# EasyEDA Pro project Foc驱动板.eprj, board PCB1 (continued)
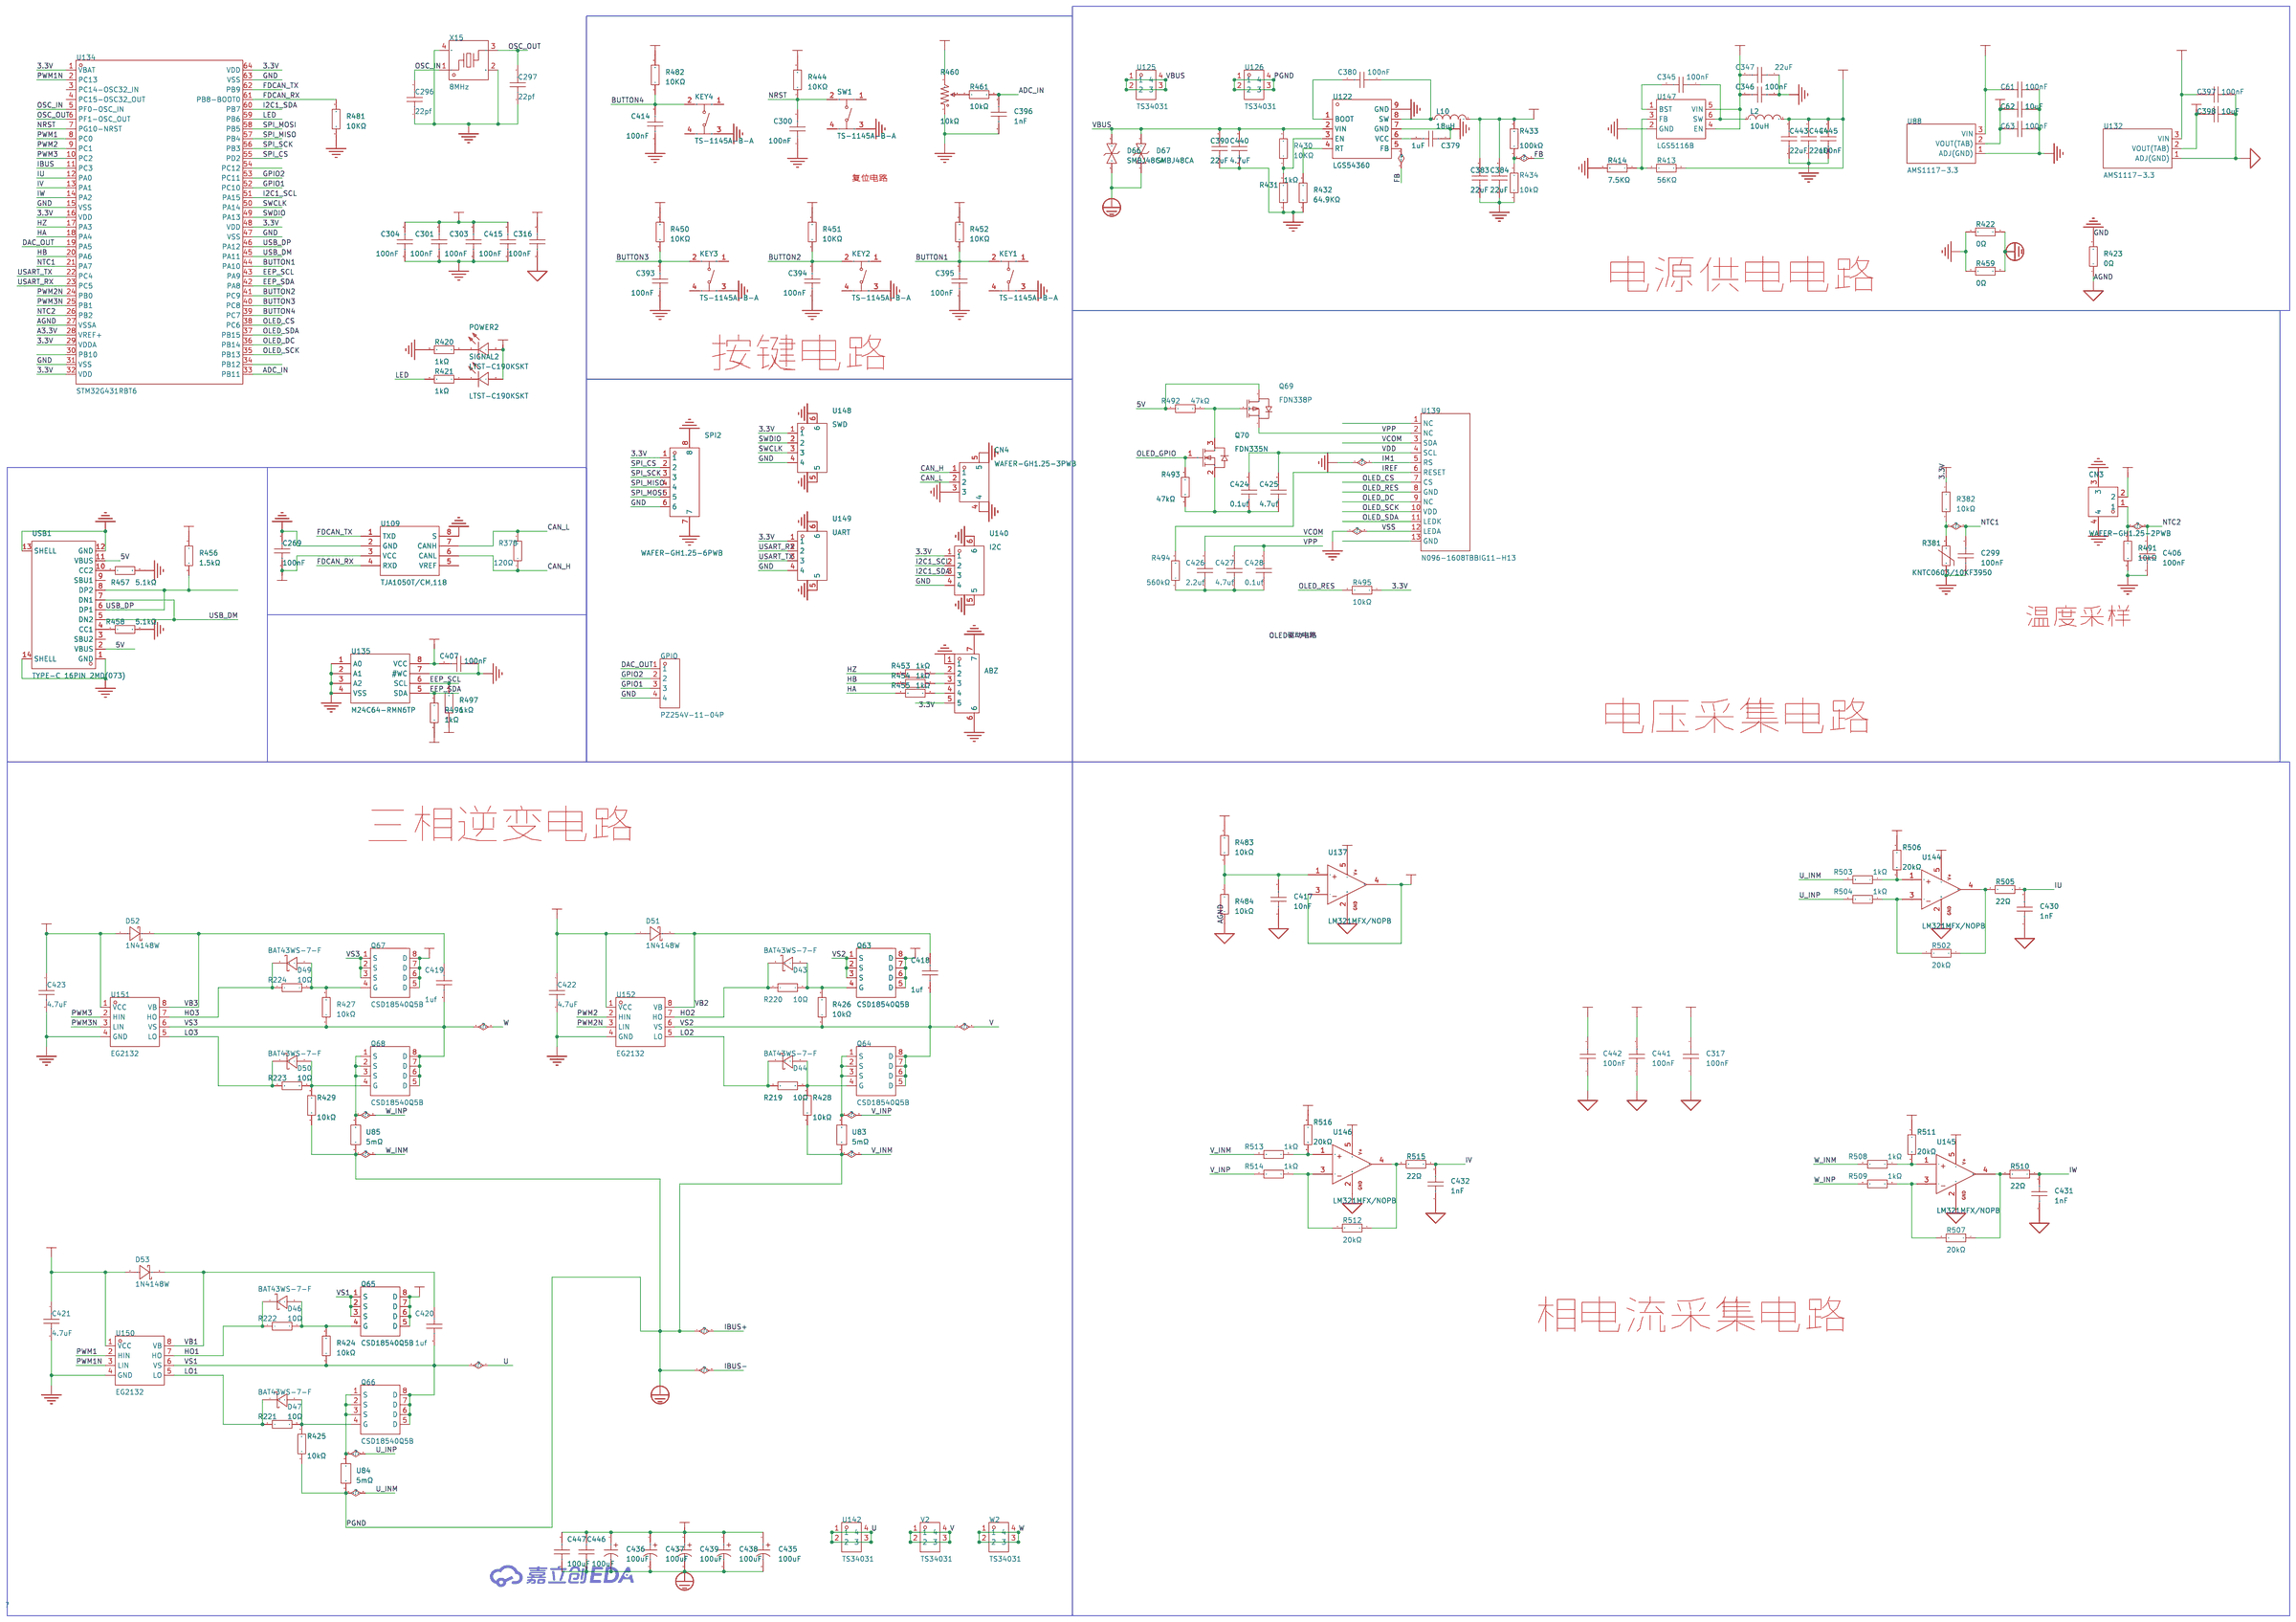
[diagram p0: schematic sheet]
## Routing (per net, layer and track width the routed paths; a pad name or vN(x,y) marks a point on that pad's centre or on a via; arc(x,y) is an arc through that point) (continued)
PWM3N: length 25.5
  Top Layer w0.127: v2(42.8,46.35) U151.3 ; 42.07,68.45 v2(43.35,68.45)
  Bottom Layer w0.127: v2(42.8,46.35) 42.8,68.2 43.05,68.45 v2(43.35,68.45)
SPI_CS: length 67.9
  Top Layer w0.127: U134.55 12.33,68.95 12.08,69.2 v1(10.66,69.2) ; v1(9.78,55.5) 9.02,54.74 9.02,25.65 8.61,25.24 5.51,25.24
  Bottom Layer w0.127: v1(10.66,69.2) 10.03,68.58 10.03,55.75 v1(9.78,55.5)
SPI_MISO: length 69
  Top Layer w0.127: v1(10.67,54.48) 9.78,53.59 9.78,23.11 9.41,22.74 5.51,22.74 ; U134.57 11.65,67.95 v1(11.64,67.94)
  Bottom Layer w0.127: v1(11.64,67.94) 10.92,67.22 10.92,54.74 v1(10.67,54.48)
SPI_MOSI: length 69.7
  Top Layer w0.127: 5.51,21.49 9.81,21.49 10.16,21.84 10.16,53.09 v1(10.67,53.59) ; v1(11.68,67.07) 12.06,67.45 U134.58
  Bottom Layer w0.127: v1(10.67,53.59) 11.43,54.36 11.43,66.81 v1(11.68,67.07)
SPI_SCK: length 68.5
  Top Layer w0.127: v1(10.79,68.2) 11.3,68.71 11.94,68.71 12.2,68.45 U134.56 ; v1(9.78,54.61) 9.4,54.23 9.4,24.38 9.01,23.99 5.51,23.99
  Bottom Layer w0.127: v1(10.79,68.2) 10.41,67.82 10.41,55.24 v1(9.78,54.61)
SWCLK: length 27.6
  Top Layer w0.127: 5.38,74.3 5.39,74.3 7.37,74.3 7.62,74.04 7.62,71.88 8.05,71.45 U134.50
SWDIO: length 28.7
  Top Layer w0.127: U134.49 28.64,71.95 28.45,71.75 8.38,71.75 8,72.14 8,75.31 7.75,75.56 5.39,75.56 5.38,75.55
U: length 26.3
  Top Layer w0.254: C420.2 17.65,40.77 v1(17.27,40.39) U150.6
  Top Layer w0.381: v1(17.09,26.29) 17.09,26.29 13.84,26.29 13.34,26.79 R424.1
  Bottom Layer w0.381: v1(17.27,40.39) 17.27,26.46 v1(17.09,26.29)
  vias: v1(12.73,3.68) v1(13.64,3.68) v1(14.56,3.68) v1(15.39,3.68) v1(16.34,3.68) v1(17.09,25.27) v1(17.09,24.25) v1(17.09,23.24) v1(17.09,22.22) v1(17.27,7.49) v1(17.27,6.54) v1(17.27,5.63) v1(17.27,4.7) v1(17.27,2.65) v1(17.27,1.7) v1(17.27,0.78) v1(17.3,3.68) v1(18.05,26.29) v1(18.05,25.27) v1(18.05,24.26) v1(18.05,23.24) v1(18.05,22.22) v1(18.29,7.54) v1(18.29,6.58) v1(18.29,5.67) v1(18.29,4.74) v1(18.29,3.68) v1(18.29,2.69) v1(18.29,1.74) v1(18.29,0.82) v1(18.97,26.29) v1(18.97,25.27) v1(18.97,24.26) v1(18.97,23.24) v1(18.97,22.22) v1(19.24,3.68) v1(19.3,7.49) v1(19.3,6.54) v1(19.3,5.63) v1(19.3,4.7) v1(19.3,2.65) v1(19.3,1.7) v1(19.3,0.78) v1(19.92,26.29) v1(19.92,25.27) v1(19.92,24.25) v1(19.92,23.24) v1(19.92,22.22) v1(20.19,3.68) v1(20.88,26.29) v1(20.88,25.27) v1(20.88,24.25) v1(20.88,23.24) v1(20.88,22.22) v1(21.11,3.68) v1(21.94,3.68) v1(22.83,3.68) v1(23.72,3.68)
U_INP: length 45.5
  Top Layer w0.203: v1(14.86,16.13) 15.19,15.8 18.59,15.8 18.92,16.13 18.92,18.56
  Top Layer w0.254: v1(14.22,49.28) 14.87,49.28 IN-.2
  Inner2 w0.203: v1(14.86,16.13) 14.6,15.88 12.32,15.88 12.19,16 12.19,48.89 12.57,49.28 v1(14.22,49.28)
USART_RX: length 44.8
  Top Layer w0.127: U134.23 v2(34.04,67.45) ; v1(6.36,66.55) 6.35,66.54 5.38,66.54
  Bottom Layer w0.127: v2(34.04,67.45) 14.47,67.45 14.22,67.69 14.22,71.37 13.84,71.75 8.13,71.75 7.62,71.25 7.62,67.81 v1(6.36,66.55)
USART_TX: length 45.8
  Top Layer w0.127: U134.22 v2(33.4,66.95) ; 5.38,65.29 6.35,65.29 v1(6.36,65.28)
  Bottom Layer w0.127: v1(6.36,65.28) 8,66.92 8,71.12 8.38,71.5 13.46,71.5 13.84,71.12 13.84,67.44 14.33,66.95 v2(33.4,66.95)
USB_DM: length 64
  Top Layer w0.127: v1(6.1,55.24) 6.1,54.1 5.97,53.97 5.33,53.97 4.83,53.47 4.83,44.7 5.08,44.45 6.35,44.45 ; 6.35,44.45 6.59,44.69 USB.5 ; 6.35,44.45 6.35,43.94 6.6,43.69 7.45,43.69 USB.7 ; v2(34.07,70.61) U134.45
  Inner2 w0.127: v2(34.07,70.61) 12.57,70.61 11.81,71.37 6.1,71.37 5.84,71.12 5.84,55.5 v1(6.1,55.24)
USB_DP: length 68.3
  Top Layer w0.127: USB.6 7.46,44.2 8.38,44.2 8.51,44.07 8.51,43.31 8.39,43.19 USB.8 7.44,43.18 4.32,43.18 4.06,43.43 4.06,50.67 3.8,50.94 3.17,50.94 3.04,51.06 3.04,53.46 3.94,54.36 5.21,54.36 5.33,54.48 5.33,55.2 v1(5.29,55.24) ; v2(33.57,71.12) U134.46
  Inner2 w0.127: v1(5.29,55.24) 5.59,55.54 5.59,71.37 5.97,71.75 11.81,71.75 12.45,71.12 v2(33.57,71.12)
V: length 26.4
  Top Layer w0.254: U152.6 v1(29.46,40.51) 29.91,40.96 C418.2
  Top Layer w0.381: R426.1 27.31,26.92 28.07,26.16 30.87,26.16 v1(30.87,26.16)
  Bottom Layer w0.381: v1(30.87,26.16) 30.48,26.55 30.48,29.84 29.46,30.86 v1(29.46,40.51)
  vias: v1(26.25,3.62) v1(27.17,3.62) v1(28.08,3.62) v1(28.91,3.62) v1(29.86,3.62) v1(30.87,25.14) v1(30.87,24.13) v1(30.87,23.11) v1(30.87,22.09) v1(30.8,7.43) v1(30.8,6.48) v1(30.8,5.56) v1(30.8,4.63) v1(30.82,3.62) v1(30.8,2.58) v1(30.8,1.63) v1(30.8,0.72) v1(31.83,26.16) v1(31.83,25.14) v1(31.83,24.13) v1(31.83,23.11) v1(31.83,22.1) v1(31.81,7.47) v1(31.81,6.52) v1(31.81,5.6) v1(31.81,4.67) v1(31.81,3.62) v1(31.81,2.63) v1(31.81,1.67) v1(31.81,0.76) v1(32.75,26.16) v1(32.75,25.14) v1(32.75,24.13) v1(32.75,23.11) v1(32.75,22.1) v1(32.76,3.62) v1(32.83,7.43) v1(32.83,6.48) v1(32.83,5.56) v1(32.83,4.63) v1(32.83,2.58) v1(32.83,1.63) v1(32.83,0.72) v1(33.7,26.16) v1(33.7,25.14) v1(33.7,24.13) v1(33.7,23.11) v1(33.7,22.09) v1(33.72,3.62) v1(34.66,26.16) v1(34.66,25.14) v1(34.66,24.13) v1(34.66,23.11) v1(34.66,22.09) v1(34.63,3.62) v1(35.46,3.62) v1(36.36,3.62) v1(37.25,3.62)
V_INP: length 45.8
  Top Layer w0.203: 32.77,18.18 32.77,15.75 32.44,15.42 29.03,15.42 v1(28.7,15.75)
  Top Layer w0.254: v1(27.69,49.54) 28.58,49.54 IN-#3.2
  Inner2 w0.203: 27.69,49.53 26.42,49.53 26.03,49.15 26.03,15.75 26.29,15.49 28.45,15.49 v1(28.7,15.75)
VCOM: length 19.2
  Top Layer w0.254: C426.2 31.24,80.55 v1(31.24,81.41) ; 20.95,80.77 20.83,80.77 20.45,80.4 1.3 OLED.3
  Bottom Layer w0.254: v1(31.24,81.41) 21.46,81.41 v1(20.95,80.9)
VPP: length 19.2
  Top Layer w0.254: 27.9,80.52 PMOS.2 ; 27.9,80.52 22.1,80.52 21.15,79.57 1.3 OLED.2 ; 27.9,80.52 29.53,80.52 C427.2 ; 27.9,80.52 C428.2
VREF: length 38.2
  Top Layer w0.254: v1(42.13,53.57) 42.13,52.8 ; v1(14.99,53.59) R506.1 ; v1(45.69,55.37) U137.3 U137.4 ; v1(28.54,53.62) 28.54,52.73
  Inner2 w0.254: v1(14.99,53.59) 28.51,53.59 v1(28.54,53.62) 42.07,53.62 v1(42.13,53.57) 45.44,53.57 45.69,53.82 v1(45.69,55.37)
VS3: length 26.3
  Top Layer w0.254: U151.6 v1(42.8,40.64) 43.25,41.09 C419.2
  Top Layer w0.381: v1(43.63,26.28) 43.63,26.29 40.89,26.29 40.01,27.17 R427.1
  Bottom Layer w0.381: v1(42.8,40.64) 42.8,29.59 43.18,29.21 43.18,26.74 v1(43.63,26.28)
  vias: v1(39.46,3.59) v1(40.38,3.59) v1(41.29,3.59) v1(42.12,3.59) v1(43.07,3.59) v1(43.63,25.27) v1(43.63,24.25) v1(43.63,23.24) v1(43.63,22.22) v1(44,7.4) v1(44,6.45) v1(44,5.53) v1(44,4.6) v1(44.03,3.59) v1(44,2.56) v1(44,1.6) v1(44,0.69) v1(44.59,26.29) v1(44.59,25.27) v1(44.59,24.25) v1(44.59,23.24) v1(44.59,22.22) v1(45.02,7.44) v1(45.02,6.49) v1(45.02,5.57) v1(45.02,4.64) v1(45.02,3.59) v1(45.02,2.6) v1(45.02,1.64) v1(45.02,0.73) v1(45.51,26.29) v1(45.51,25.27) v1(45.51,24.25) v1(45.51,23.24) v1(45.51,22.22) v1(45.97,3.59) v1(46.04,7.4) v1(46.04,6.45) v1(46.04,5.53) v1(46.04,4.6) v1(46.04,2.56) v1(46.04,1.6) v1(46.04,0.69) v1(46.46,26.28) v1(46.46,25.27) v1(46.46,24.25) v1(46.46,23.24) v1(46.46,22.22) v1(46.93,3.59) v1(47.42,26.28) v1(47.42,25.27) v1(47.42,24.25) v1(47.42,23.24) v1(47.42,22.22) v1(47.84,3.59) v1(48.67,3.59) v1(49.57,3.59) v1(50.46,3.59)
W_INP: length 46.2
  Top Layer w0.203: v1(41.4,15.88) 41.73,15.54 45.14,15.54 45.47,15.88 45.47,18.31
  Top Layer w0.254: IN-#2.2 v1(41.28,49.53)
  Inner2 w0.203: v1(41.28,49.53) 39.37,49.53 38.86,49.02 38.86,15.88 39.12,15.62 41.15,15.62 v1(41.4,15.88)
$1N9140: length 5.4
  Top Layer w0.254: POWER.1 42.32,82.14 42.67,81.79 42.67,78.61 42.42,78.36 41.7,78.36 R420.1
$1N9141: length 2.3
  Top Layer w0.254: 41.72,89.38 R421.1
$1N9145:
  vias: v1(52.45,48.39) v1(53.65,48.39) v1(54.61,48.39) v1(55.5,48.39) v1(56.64,48.33) v1(57.78,53.21) v1(57.78,52.28) v1(57.85,51.31) v1(57.85,50.37) v1(57.85,49.34) v1(57.78,48.39) v1(59.69,57.15) v1(59.69,56.26) v1(59.69,55.31) v1(60.58,57.15)
$1N9147: length 7.3
  Top Layer w0.254: U122.6 v1(64.03,56.44) ; C379.2 v1(66.67,59.82)
  Bottom Layer w0.254: v1(66.67,59.82) 64.52,59.82 64.03,59.34 v1(64.03,56.44)
$1N9157: length 9.6
  Top Layer w0.254: R431.2 68.71,45.86 68.71,46.86 68.45,47.12 67.18,47.12 67.06,47.24 R430.1 66.42,48.01 66.17,48.26 66.17,49.91 65.91,50.16 64.39,50.16 64.03,50.52 U122.3
$1N9158: length 4.5
  Top Layer w0.254: U122.4 66.1,51.51 66.29,51.31 68.2,51.31 68.58,50.93 68.58,49.92 R432.2
$1N9186: length 15.1
  Top Layer w0.127: R457.1 1.91,50.29 1.14,49.53 1.14,42.67 1.65,42.16 7.43,42.16 USB.10
$1N9188: length 8.1
  Top Layer w0.127: USB.4 7.43,45.21 5.59,45.21 5.46,45.34 5.46,50.68 5.71,50.94 R458.1
$1N9190: length 6.5
  Top Layer w0.127: 53.59,92.33 53.09,91.83 53.09,89.67 52.97,89.54 R461.1
$1N9204: length 2.8
  Top Layer w0.127: R453.1 7.69,13.7 5.51,13.7
$1N9205: length 2.7
  Top Layer w0.127: 5.51,12.45 8.01,12.45 8.14,12.32
$1N9206: length 3
  Top Layer w0.127: 8.14,10.54 8.14,10.79 7.73,11.2 5.51,11.2
$1N9242: length 11.3
  Top Layer w0.381: Q65.4 v1(21.72,28.47) ; v1(15.49,28.45) R424.2 R222.2 14.85,31.36 D46.2
  Inner2 w0.381: v1(15.49,28.45) 21.7,28.45 v1(21.72,28.47)
$1N9243: length 12.2
  Top Layer w0.381: D47.2 14.85,23.58 R221.2 R425.2 v1(15.75,20.45) ; Q66.4 22.09,20.44 v1(22.1,20.45)
  Inner2 w0.381: v1(22.1,20.45) v1(15.75,20.45)
$1N9259: length 10.9
  Top Layer w0.381: D43.2 28.82,31.21 R220.2 R426.2 29.46,28.32 ; Q63.4 v1(35.56,28.32)
  Inner2 w0.381: v1(29.66,28.32) 35.56,28.32
$1N9267: length 12
  Top Layer w0.381: Q64.4 v1(35.81,20.31) ; v1(29.46,20.32) R428.2 R219.2 28.69,23.46 D44.2
  Inner2 w0.381: v1(35.81,20.31) 35.8,20.32 v1(29.46,20.32)
$1N9279: length 11.7
  Top Layer w0.381: Q68.4 v1(48.51,20.43) ; v1(42.29,20.45) R429.2 R223.2 41.52,23.46 D50.2
  Inner2 w0.381: v1(48.51,20.43) 48.5,20.45 v1(42.29,20.45)
$1N9280: length 11.3
  Top Layer w0.381: 47.43,28.45 v1(48.26,28.45) ; v1(42.29,28.45) R427.2 41.52,31.59 41.94,32
  Inner2 w0.381: v1(42.29,28.45) 48.26,28.45
$1N9505: length 2.4
  Top Layer w0.254: 59.63,52.26 59.69,52.2 59.69,51.82 60,51.51 U122.1
$1N9527: length 4.5
  Top Layer w0.254: NMOS.3 29.53,86.67 29.84,86.36 29.84,84.66 PMOS.1 31.18,84.61 R492.2
$1N9530: length 9.3
  Top Layer w0.254: C425.1 C424.1 27.84,91.05 NMOS.2 27.84,88.11 28.32,87.63 29.59,87.63 30.08,87.14 R493.1
$1N9531: length 21.8
  Top Layer w0.254: C428.1 31.16,79.07 C426.1 31.99,79.11 32.38,79.5 32.38,94.23 31.98,94.64 R494.1
$1N9558: length 5.9
  Top Layer w0.254: U137.1 44.99,58.67 43.58,58.67 R483.2 43.53,57.02 R484.1 43.52,55.26 C417.2
$1N10528: length 4
  Top Layer w0.203: IU.1 16.69,51.24 IN+.1 R506.2
$1N10530: length 3.9
  Top Layer w0.203: 16.56,49.34 IN-.1 ; 16.56,49.34 16.5,49.28 R502.2 ; 16.56,49.34 IU.3
$1N10535: length 11.6
  Top Layer w0.203: OUT.2 23.17,49.34 21.37,49.34 21.34,49.31 21.34,47.12 21.08,46.86 15.11,46.86 14.99,46.98 R502.1
$1N10928: length 3.4
  Top Layer w0.203: IW.1 45.28,51.18 IN+#2.1 R511.2
$1N10931: length 3.4
  Top Layer w0.203: R507.2 IN-#2.1 43.82,49.39 45.39,49.39
$1N10936: length 10.8
  Top Layer w0.203: R507.1 42.17,47.24 42.42,46.99 47.62,46.99 48.01,47.37 48.01,49.38 47.99,49.39 49.64,49.39 OUT#2.2
$1N11280: length 3.9
  Top Layer w0.203: R516.2 IN+#3.1 30.28,51.37 IV.1
$1N11283: length 3.8
  Top Layer w0.203: R512.2 IN-#3.1 32.17,49.53 IV.3
$1N11288: length 11.3
  Top Layer w0.203: OUT#3.2 36.51,49.47 IV.4 34.92,49.37 34.92,47.37 34.54,46.99 28.83,46.99 28.58,47.24 R512.1

## Copper pours and planes (outline as drawn; the poured copper is in the pictures)
3.3V on Top Layer: 46.53,75.56 46.53,68.58 49.16,68.58 49.16,75.55 49.14,75.56
3.3V on Top Layer: 46.61,84.2 48.26,84.2 48.26,79.63 46.61,79.63
3.3V on Inner2: 3.3,54.4 5.05,54.4 5.05,52.84 3.3,52.84
3.3V on Inner2: 46.61,82.91 46.61,90.68 46.86,90.93 46.86,95.25 48.51,95.25 48.51,89.99 48.25,89.72 48.25,82.91
3.3V on Inner2: 46.61,68.71 48.26,68.71 48.26,81.53 46.61,81.53
3.3V on Inner2: 46.61,84.33 48.26,84.33 48.26,82.55 46.61,82.55
5V on Top Layer: 49.53,67.62 49.53,65.7 50.42,65.7 50.42,64.86 52.35,64.86 52.35,66.29 52,66.29 52,67.69 49.6,67.69
5V on Top Layer: 50.16,78.23 50.16,76.18 50.67,76.18 50.67,75.39 53.49,75.39 53.49,73.38 56.63,73.38 56.63,78.29 50.22,78.29
5V on Top Layer: 54.1,74.3 56.51,74.3 56.51,68.2 54.1,68.2
5V on Top Layer: 28.41,83.63 31.83,83.63 31.83,81.98 28.4,81.98 28.4,83.62
5V on Top Layer: 54.1,70.74 54.1,64.52 55.4,64.52 55.4,68.21 56.57,68.2 56.57,70.74
5V on Bottom Layer: 52.83,77.85 52.83,67.61 52.81,67.59 49.81,67.59 49.78,67.56 49.78,65.79 55.12,65.79 55.12,77.85
12V on Top Layer: 19.53,45.39 19.53,43.35 23.3,43.35 23.3,40.47 25.68,40.47 25.68,45.3 25.6,45.39
12V on Top Layer: 52.13,56.32 51.44,56.32 51.44,53.97 57.28,53.97 57.28,56.39 56.93,56.39 56.93,58.27 61.61,58.27 61.61,62.38 58.55,62.38 58.55,59.79 55.96,59.79 55.61,59.44 52.13,59.44
12V on Top Layer: 31.5,45.72 31.5,43.69 35.27,43.69 35.27,40.8 37.65,40.8 37.65,45.63 37.57,45.72
12V on Top Layer: 44.93,45.64 44.93,43.74 48.7,43.74 48.7,41.61 51.89,41.61 51.89,45.64
12V on Bottom Layer: 22.73,45.47 50.8,45.47 50.8,43.69 22.73,43.69
12V on Bottom Layer: 58.41,64.12 58.41,63.13 58.42,63.12 59.71,63.12 59.71,61.36 59.69,61.34 58.55,61.34 58.55,59.95 56.13,59.95 55.63,59.44 55.62,59.44 52.31,59.44 52.31,57.61 56.88,57.61 56.9,57.98 56.9,58.29 61.47,58.29 61.47,60.53 62.43,60.53 62.48,60.58 62.48,63.42 61.14,63.42 61.14,64.07 61.09,64.12
12V on Inner2: 52.2,59.44 56.77,59.44 56.9,59.31 56.9,57.13 54.85,57.13 54.74,57.02 54.74,49.01 51.56,49.01 51.56,43.81 48.32,43.81 48.32,50.63 52.2,50.63
A3.3V on Top Layer: 46.61,64.9 46.61,62.61 47.68,62.61 47.68,61.01 47.5,60.83 46.65,60.83 46.65,59.89 49.68,59.89 49.68,64.9
GND on Top Layer: 64.52,45.47 64.39,45.34 67.64,45.34 67.64,46.58 65.89,46.58 65.89,49.31 64.52,49.31
GND on Top Layer: 55.75,62.48 58.17,62.48 58.17,61.59 55.75,61.59
GND on Top Layer: 60.96,52.58 66.14,52.58 66.14,51.97 66.17,51.94 68.1,51.94 68.1,53.09 66.89,53.09 66.89,55.24 66.19,55.24 66.19,56.49 66.17,56.52 64.76,56.52 64.76,55.88 63.38,55.88 63.38,57.96 62.04,57.96 62.04,56.55 61.41,56.55 60.96,56.1
GND on Top Layer: 57.15,63.88 57.15,60.58 54.23,60.58 54.23,59.97 58.31,59.97 58.31,63.88
GND on Top Layer: 53.21,60.58 55.12,60.58 55.12,59.56 53.21,59.56
GND on Top Layer: -9.02,104.65 79.38,104.65 79.38,-6.35 -9.02,-6.35
GND on Bottom Layer: -17.27,114.3 86.87,114.3 86.87,-18.16 -17.27,-18.16
GND on Inner1: -13.97,109.6 84.71,109.6 84.71,-12.45 -13.97,-12.45
GND on Inner2: -21.21,116.08 91.95,116.08 91.95,-18.92 -21.21,-18.92
PGND on Top Layer: 51.82,34.54 55.88,34.54 55.88,3.94 51.82,3.94
PGND on Top Layer: 14.35,8.51 14.35,11.81 17.19,11.81 17.19,13.03 20.65,13.03 20.65,11.74 20.7,11.68 30.86,11.68 30.86,12.95 34.42,12.95 34.42,11.61 43.74,11.61 43.81,11.68 43.81,13.09 47.32,13.09 47.32,11.68 49.02,11.68 49.02,8.53 14.37,8.53
PGND on Top Layer: 35.69,31.46 38.86,31.46 38.86,9.18 35.69,9.18
PGND on Top Layer: 65.41,25.78 65.41,22.89 61.11,22.89 61.09,22.86 61.09,17 68.94,17 69.09,17.15 69.09,25.78
PGND on Top Layer: 47.37,11.68 53.48,11.68 53.48,8.61 47.37,8.61
PGND on Top Layer: 49.15,25.02 52.83,25.02 52.83,10.54 49.15,10.54
PGND on Top Layer: 21.84,31.5 25.27,31.5 25.27,10.48 21.84,10.48
PGND on Top Layer: 61.09,19.94 69.09,19.94 69.09,7.24 61.09,7.24
PGND on Top Layer: 61.72,47.5 52.2,47.5 52.2,41.78 56.1,41.78 56.1,44.67 56.13,44.7 60.32,44.7 61.72,46.1
PGND on Bottom Layer: 60.71,20.19 60.71,34.67 51.56,34.67 51.56,3.81 62.36,3.81 62.48,3.94 62.48,6.98 62.74,7.24 69.22,7.24 69.22,20.19
PGND on Bottom Layer: 65.34,25.6 65.34,22.71 61.05,22.71 61.02,22.68 61.02,16.82 68.88,16.82 69.02,16.96 69.02,25.6
PGND on Inner1: 52.32,47.68 52.32,41.82 55.92,41.82 56.01,41.91 56.01,44.45 56.26,44.7 60.32,44.7 61.59,45.97 61.59,47.66 61.57,47.68
PGND on Inner1: 51.24,34.54 51.24,25.65 49.15,25.65 49.15,8.64 51.79,8.64 51.79,3.94 55.75,3.94 55.88,3.81 62.36,3.81 62.36,7.3 69.09,7.3 69.09,19.81 68.96,19.94 60.58,19.94 60.58,34.54
PGND on Inner1: 65.34,25.73 65.34,22.83 61.05,22.83 61.02,22.81 61.02,16.94 68.88,16.94 69.02,17.09 69.02,25.73
PGND on Inner2: 52.36,44.7 52.36,47.62 61.72,47.62 61.72,46.04 60.39,44.7
PGND on Inner2: 52.32,45.72 52.32,43.18 50.71,43.18 50.71,32.98 50.67,32.95 51.8,32.95 51.8,30.5 51.94,30.35 55.75,30.35 55.88,30.23 55.88,34.8 55.75,34.92 53.8,34.92 53.8,40.64 56.01,40.64 56.13,40.77 56.13,45.76 52.36,45.76
PGND on Inner2: 51.82,31.75 51.82,25.65 49.28,25.65 49.15,25.53 49.15,8.61 51.8,8.61 51.8,0.75 51.56,0.51 68.96,0.51 68.96,19.94 61.09,19.94 61.09,3.43 56.1,3.43 55.77,31.75
PGND on Inner2: 65.47,25.73 65.47,22.83 61.18,22.83 61.15,22.81 61.15,16.94 69,16.94 69.15,17.09 69.15,25.73
VBUS on Top Layer: 59.94,29.59 59.94,23.18 65.09,23.18 65.15,23.24 65.15,26.15 68.45,26.16 68.58,26.29 68.58,29.34 68.33,29.59
VBUS on Top Layer: 50.8,41.27 50.8,37.34 46.48,37.34 46.48,35.18 46.61,35.05 46.61,34.73 58.93,34.73 58.93,41.15 58.8,41.27
VBUS on Top Layer: 35.69,34.25 38.99,34.25 38.99,32.09 35.69,32.09
VBUS on Top Layer: 21.97,34.54 25.27,34.54 25.27,32.38 21.97,32.38
VBUS on Top Layer: 62.1,52.2 62.1,45.97 60.45,44.32 56.44,44.32 56.44,3.81 60.83,3.81 60.83,28.45 61.21,28.83 68.45,28.83 68.58,28.96 68.58,45.08 64.26,45.08 64.13,45.21 64.13,49.74 63.33,50.55 63.33,52.18 63.31,52.2
VBUS on Top Layer: 16.38,29.59 16.38,37.34 48.26,37.34 48.26,29.59 43.08,29.59 43.08,32.87 42.93,33.02 21.46,33.02 21.46,29.59
VBUS on Bottom Layer: 50.99,40.96 50.99,37.15 44.51,37.15 44.39,37.02 44.39,34.99 44.13,34.73 61.02,34.73 61.02,28.76 68.64,28.76 68.64,44.64 68.52,44.77 64.51,44.77 64.2,45.08 64.2,49.47 63.31,50.35 63.31,52.01 62.16,52.01 62.16,45.78 60.52,44.14 60.52,44.13 56.58,44.13 56.58,41.08 56.45,40.96
VBUS on Bottom Layer: 61.09,29.72 61.09,23.19 64.97,23.19 65.15,23.37 65.15,26.28 68.45,26.29 68.58,26.42 68.58,29.47 68.33,29.72
VBUS on Inner1: 50.93,41.15 50.93,37.34 44.45,37.34 44.32,37.21 44.32,35.18 44.07,34.92 60.96,34.92 60.96,28.96 68.58,28.96 68.58,44.83 68.45,44.96 64.45,44.96 64.13,45.27 64.13,49.66 63.25,50.55 63.25,52.2 62.1,52.2 62.1,45.97 60.45,44.33 60.45,44.32 56.51,44.32 56.51,41.27 56.39,41.15
VBUS on Inner1: 60.96,29.7 60.96,23.29 65.09,23.29 65.09,26.26 68.45,26.26 68.45,29.7
VBUS on Inner2: 59.88,29.49 59.88,23.08 65.03,23.08 65.08,23.14 65.08,26.05 68.39,26.06 68.51,26.19 68.51,29.23 68.26,29.49
VBUS on Inner2: 56.51,44.2 56.51,40.51 54.36,40.51 54.23,40.39 54.23,35.18 56.39,35.18 56.51,35.05 56.51,3.79 60.82,3.79 60.83,3.81 60.83,28.45 61.21,28.83 68.58,28.83 68.58,44.96 68.45,45.08 64.39,45.08 64.13,45.34 64.13,49.66 63.25,50.55 63.25,52.21 62.1,52.21 62.1,45.97 60.45,44.32 56.64,44.32
BUTTON4 on Top Layer: 63.37,66.55 64.52,66.55 64.52,64.01 63.37,64.01
U on Top Layer: 12.38,8.02 24.19,8.02 24.19,0.28 12.38,0.28
U on Top Layer: 16.38,29.34 16.38,21.59 21.45,21.59 21.45,27.42 21.46,27.43 20.25,27.43 20.25,29.34
U on Bottom Layer: 16.38,26.8 21.34,26.8 21.34,0.76 16.38,0.76
U on Bottom Layer: 12.38,7.87 24.19,7.87 24.19,0.13 12.38,0.13
U on Inner1: 12.38,7.97 24.19,7.97 24.19,0.23 12.38,0.23
U_INP on Top Layer: 16.51,21.08 16.51,17.78 20.65,17.78 20.65,19.56 20.29,19.56 20.29,21.11 16.54,21.11
V on Top Layer: 30.21,29.02 30.21,21.27 35.28,21.27 35.28,27.1 35.29,27.11 34.08,27.11 34.08,29.02
V on Top Layer: 25.65,8 37.47,8 37.47,0.25 25.65,0.25
V on Bottom Layer: 25.72,8.06 37.53,8.06 37.53,0.32 25.72,0.32
V on Bottom Layer: 30.29,27.07 35.24,27.07 35.24,1.04 30.29,1.04
V on Inner1: 25.59,7.94 37.4,7.94 37.4,0.19 25.59,0.19
V_INP on Top Layer: 30.23,20.95 30.23,17.78 34.42,17.78 34.42,19.34 34.08,19.34 34.08,20.97 30.24,20.97
VB1 on Top Layer: 19.49,39.96 24.87,39.96 24.87,37.8 19.45,37.8 19.45,39.92
VB2 on Top Layer: 31.75,40.07 37.13,40.07 37.13,37.91 31.71,37.91 31.71,40.03
VB3 on Top Layer: 44.96,40.26 50.34,40.26 50.34,38.1 44.92,38.1 44.92,40.22
VS3 on Top Layer: 39.05,8.07 50.86,8.07 50.86,0.33 39.05,0.33
VS3 on Top Layer: 42.91,29.14 42.91,21.39 47.97,21.39 47.97,27.22 47.99,27.23 46.78,27.23 46.78,29.14
VS3 on Bottom Layer: 42.99,27.06 47.94,27.06 47.94,1.03 42.99,1.03
VS3 on Bottom Layer: 39.05,8.07 50.86,8.07 50.86,0.32 39.05,0.32
VS3 on Inner1: 39.11,8.02 50.93,8.02 50.93,0.27 39.11,0.27
W_INP on Top Layer: 43.05,21.08 43.05,17.78 47.5,17.78 47.5,19.4 46.8,19.4 46.8,21.09 46.79,21.08
$1N9085 on Top Layer: 55.88,62.74 55.88,65.66 57.52,65.66 57.52,64.22 56.96,64.22 56.96,62.72 55.89,62.72
$1N9145 on Top Layer: 61.85,56.77 61.85,58.04 58.93,58.04 58.93,55.24 57.58,53.9 51.56,53.9 51.56,48.03 58.32,48.03 58.32,50.06 59.02,50.77 59.02,52.96 60.58,52.96 60.71,53.09 60.71,56.39 61.09,56.77
$1N9145 on Bottom Layer: 61.72,56.77 61.72,58.04 58.93,58.04 58.93,55.5 57.66,54.23 57.66,53.72 51.56,53.72 51.56,47.88 58.16,47.88 58.16,50.03 58.8,50.67 58.8,51.44 58.93,51.56 60.45,51.56 60.58,51.69 60.58,56.64 60.71,56.77
$1N9145 on Inner2: 58.93,58.04 58.93,55.12 57.53,53.72 54.95,53.72 54.95,48.94 54.99,48.89 51.69,48.89 51.69,48.01 58.36,48.01 58.36,51.12 58.93,51.69 58.93,52.96 60.45,52.96 60.71,53.21 60.71,56.26 61.21,56.77 61.83,56.77 61.83,58.05 58.94,58.05
$1N24102 on Top Layer: 54.1,63.88 55.37,63.88 55.37,61.47 56.97,61.47 56.97,60.77 56.9,60.71 54.23,60.71 54.1,60.83
$1N24243 on Top Layer: 58.55,62.74 58.55,64.39 58.03,64.39 58.03,67.06 58.76,67.06 58.76,70.74 61.05,70.74 61.05,65.41 60.4,65.41 60.4,62.74

Small or netless copper shapes (teardrops, artwork), in the pictures only: 593 on Top Layer, 88 on Bottom Layer, 4 on Inner1, 65 on Inner2

## Text on the board
Top Silkscreen Layer: RESET | 2026.1.16 | STABLE 5V | STABLE 12V
